# EasyEDA Pro project Q's HelloWorld KeyBoard.eprj, schematic SCH旋钮显示屏板
Create Date: 2022-08-31; Page Name: SCH旋钮显示屏板; Project Name: Q's HelloWorld KeyBoard; Schematic Name: Schematic1; Update Date: 2023-01-22; Company: 嘉立创EDA
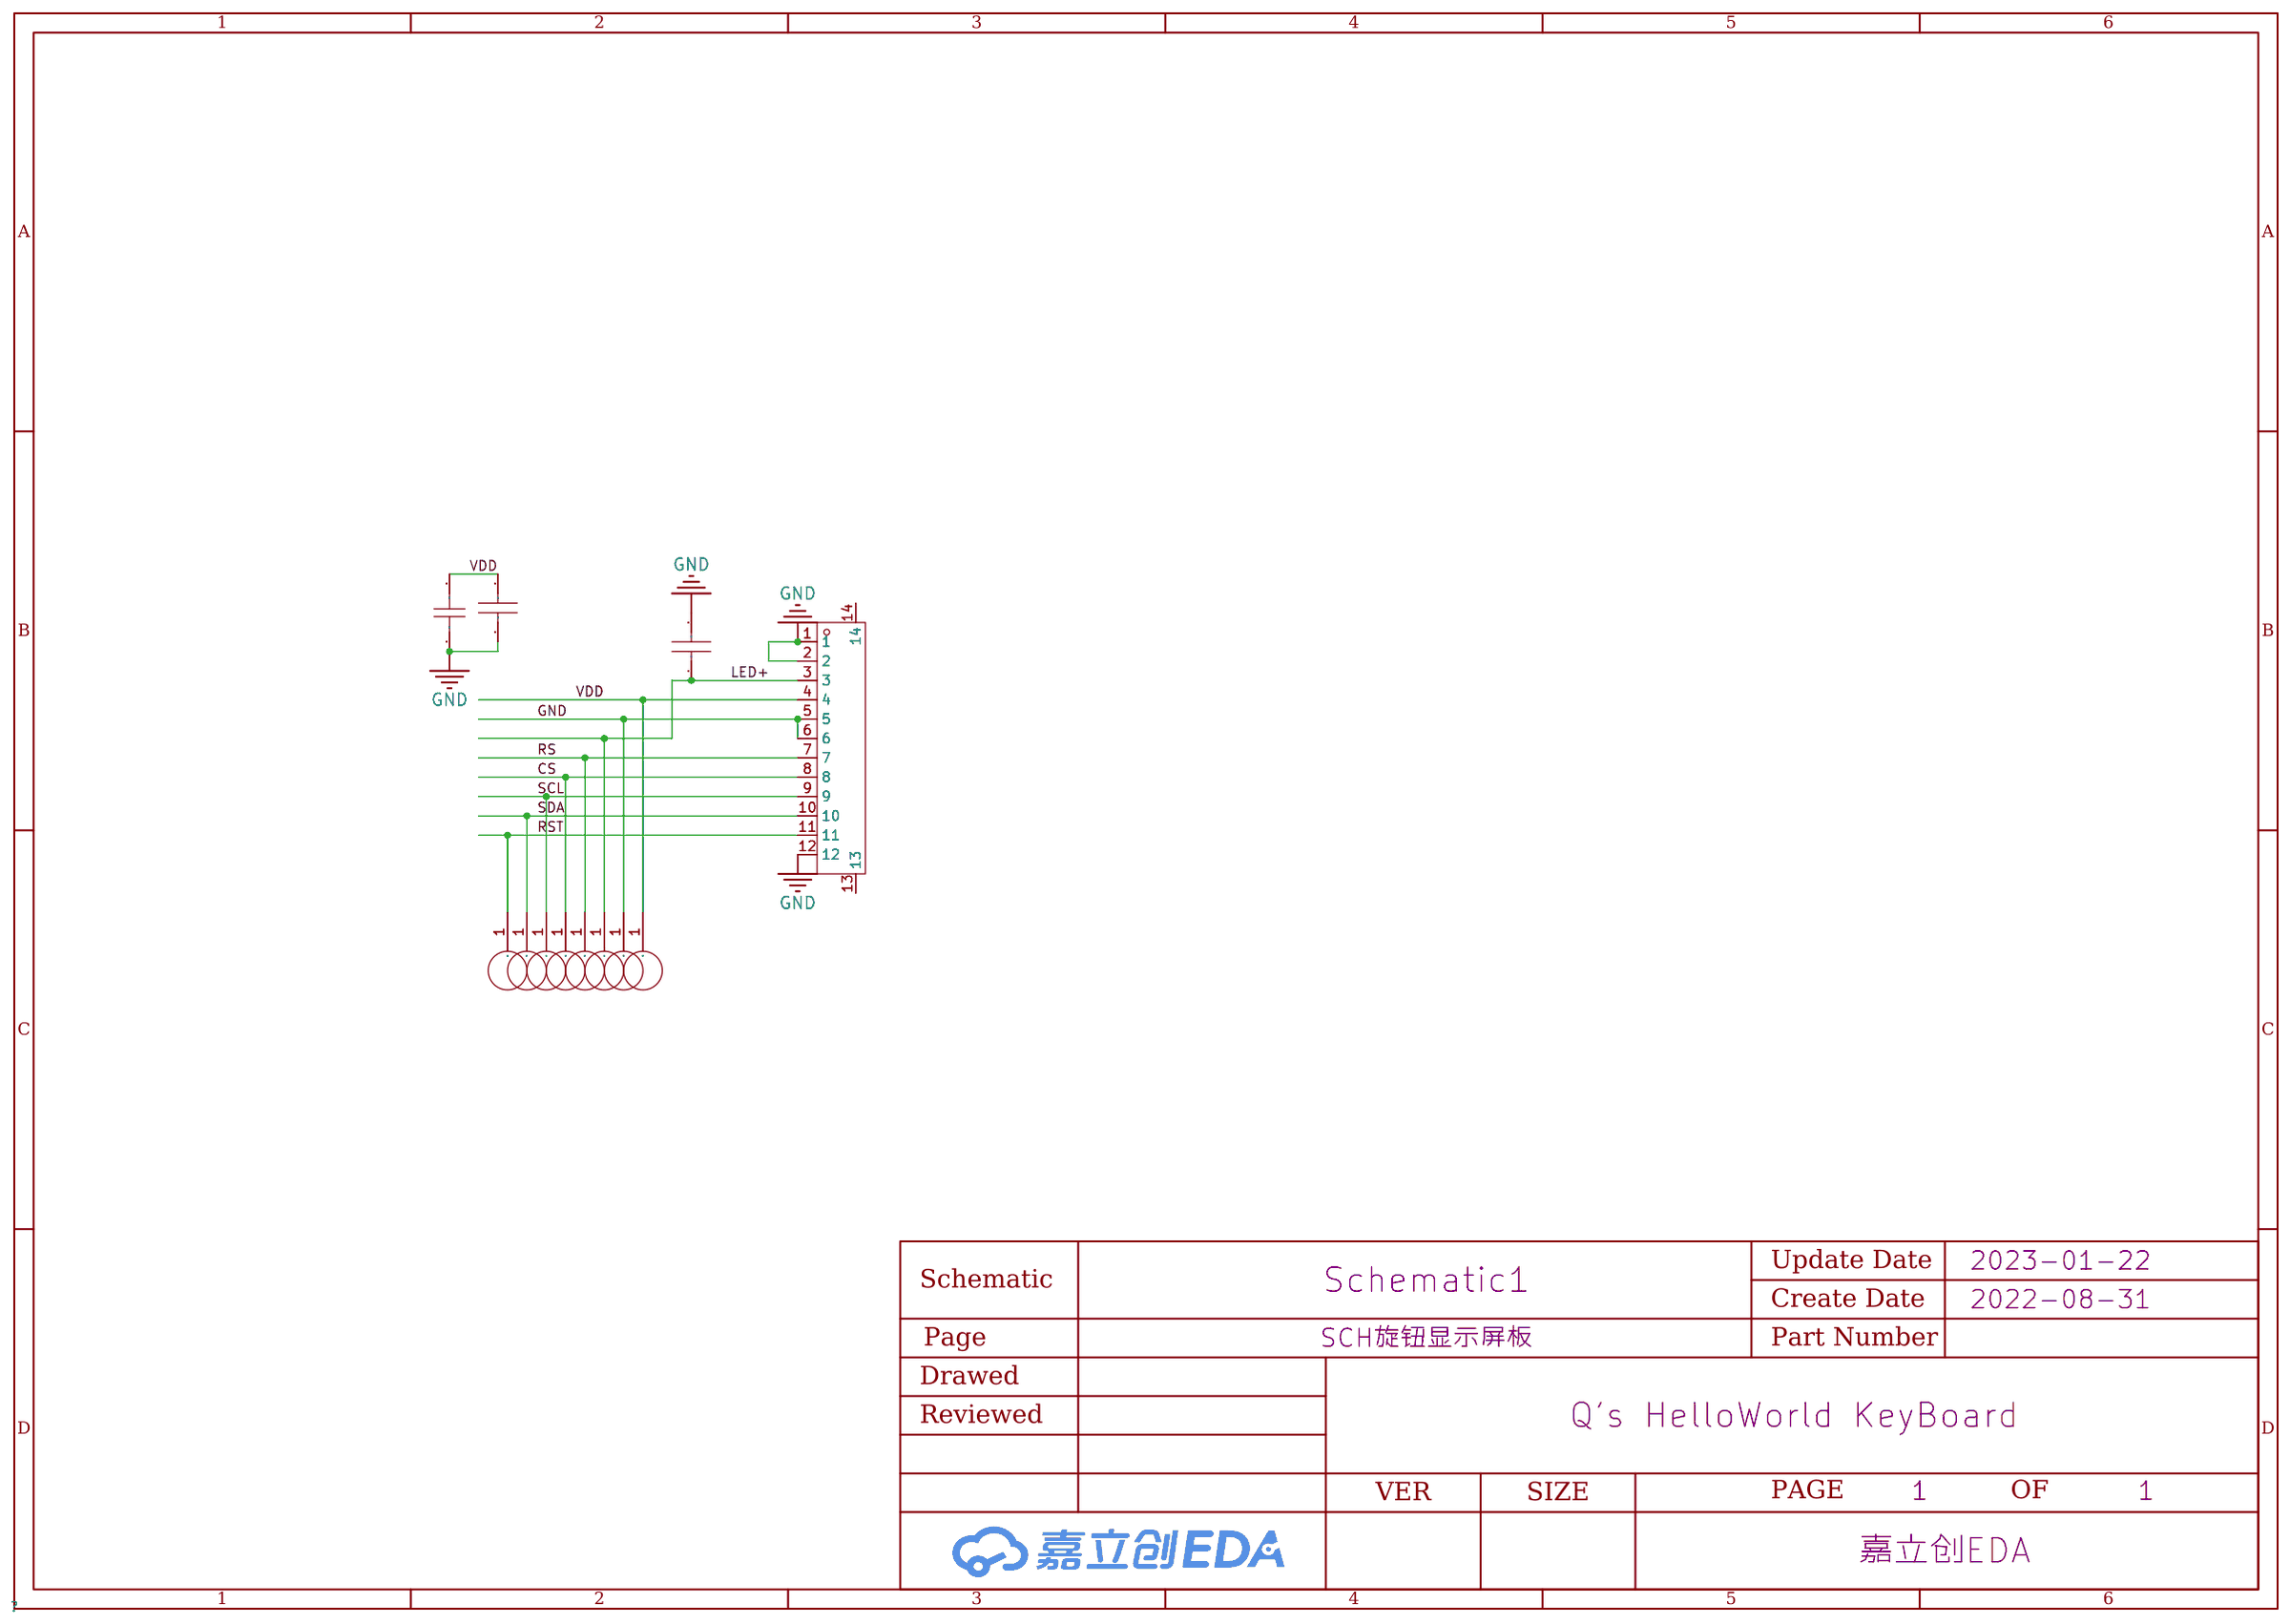
[diagram p10: schematic sheet]

## Parts
C1  2.2uF  [C0402]
C2  100nF  [C0402]
C3  2.2uF  [C0402]
FPC1  -  [FPC-SMD_5034801200]
U1  1625854-2  [TEST-RING]
U2  1625854-2  [TEST-RING]
U3  1625854-2  [TEST-RING]
U4  1625854-2  [TEST-RING]
U5  1625854-2  [TEST-RING]
U6  1625854-2  [TEST-RING]
U7  1625854-2  [TEST-RING]
U8  1625854-2  [TEST-RING]

## Library data of the parts
C1 C3 = CL05A225MQ5NSNC: 容值:2.2uF;精度:±20%;额定电压:6.3V;材质(温度系数):X5R;; LCSC Part Name: 2.2uF ±20% 6.3V; Supplier Part: C12530; Manufacturer: SAMSUNG(三星); Supplier Footprint: 0402; JLCPCB Part Class: Basic Part; Datasheet: https://atta.szlcsc.com/upload/public/pdf/source/20160103/1457707666860.pdf; Supplier: LCSC; Tolerance: ±20%; Voltage Rated: 6.3V; Temperature Coefficient: X5R
C2 = CC0402KRX7R7BB104: 容值:100nF;精度:±10%;额定电压:16V;材质(温度系数):X7R;; LCSC Part Name: 100nF ±10% 16V; Supplier Part: C60474; Manufacturer: YAGEO(国巨); Supplier Footprint: 0402; JLCPCB Part Class: Extended Part; Datasheet: https://atta.szlcsc.com/upload/public/pdf/source/20211223/9278FD768280B81DDBEF48FA36411A03.pdf; Supplier: LCSC; Tolerance: ±10%; Voltage Rated: 16V; Temperature Coefficient: X7R
FPC1 = 5034801200: 间距:0.5mm;触点数量:12;锁定特性:翻盖式;安装类型:卧贴;触点类型:双侧触点/上下接;工作温度范围:-;; LCSC Part Name: 0.5mm P数:12 翻盖式 双侧触点/上下接; Supplier Part: C587969; Manufacturer: MOLEX; Supplier Footprint: SMD,P=0.5mm; JLCPCB Part Class: Extended Part; Datasheet: https://atta.szlcsc.com/upload/public/pdf/source/20210916/4BF1C6EEFAE1EE10C092BFEE09769C70.pdf; Supplier: LCSC; Pitch: 0.5mm; Number of Contacts: 12; Locking Feature: 翻盖式; Mounting Type: 卧贴; Contact Type: 双侧触点/上下接; Height Above Board: 1mm; FFC, FCB Thickness: 0.3mm
U1-U8 = 1625854-2: 连接器类型:测试点/测试环;颜色:-;; LCSC Part Name: 测试点/测试环; Supplier Part: C306063; Manufacturer: TE Connectivity(美国泰科); JLCPCB Part Class: Extended Part; Datasheet: https://atta.szlcsc.com/upload/public/pdf/source/20181106/C306063_FA77A0AA329C0904146A791B301E5325.pdf; Supplier: LCSC; Connector Type: 测试点/测试环; Current Rating (Max): 2A

## Nets
GND: C1.2 C2.1 C3.1 FPC1.1 FPC1.2 FPC1.5 FPC1.6 FPC1.12 U2.1
VDD: C2.2 C3.2 FPC1.4 U1.1
CS: FPC1.8 U5.1
LED+: C1.1 FPC1.3 U3.1
RS: FPC1.7 U4.1
RST: FPC1.11 U8.1
SCL: FPC1.9 U6.1
SDA: FPC1.10 U7.1

Not connected (* = marked no-connect by the designer): FPC1 13 14
